# Altium schematic sheet GridSeed Old.SchDoc (part 1 of 2) (continued)
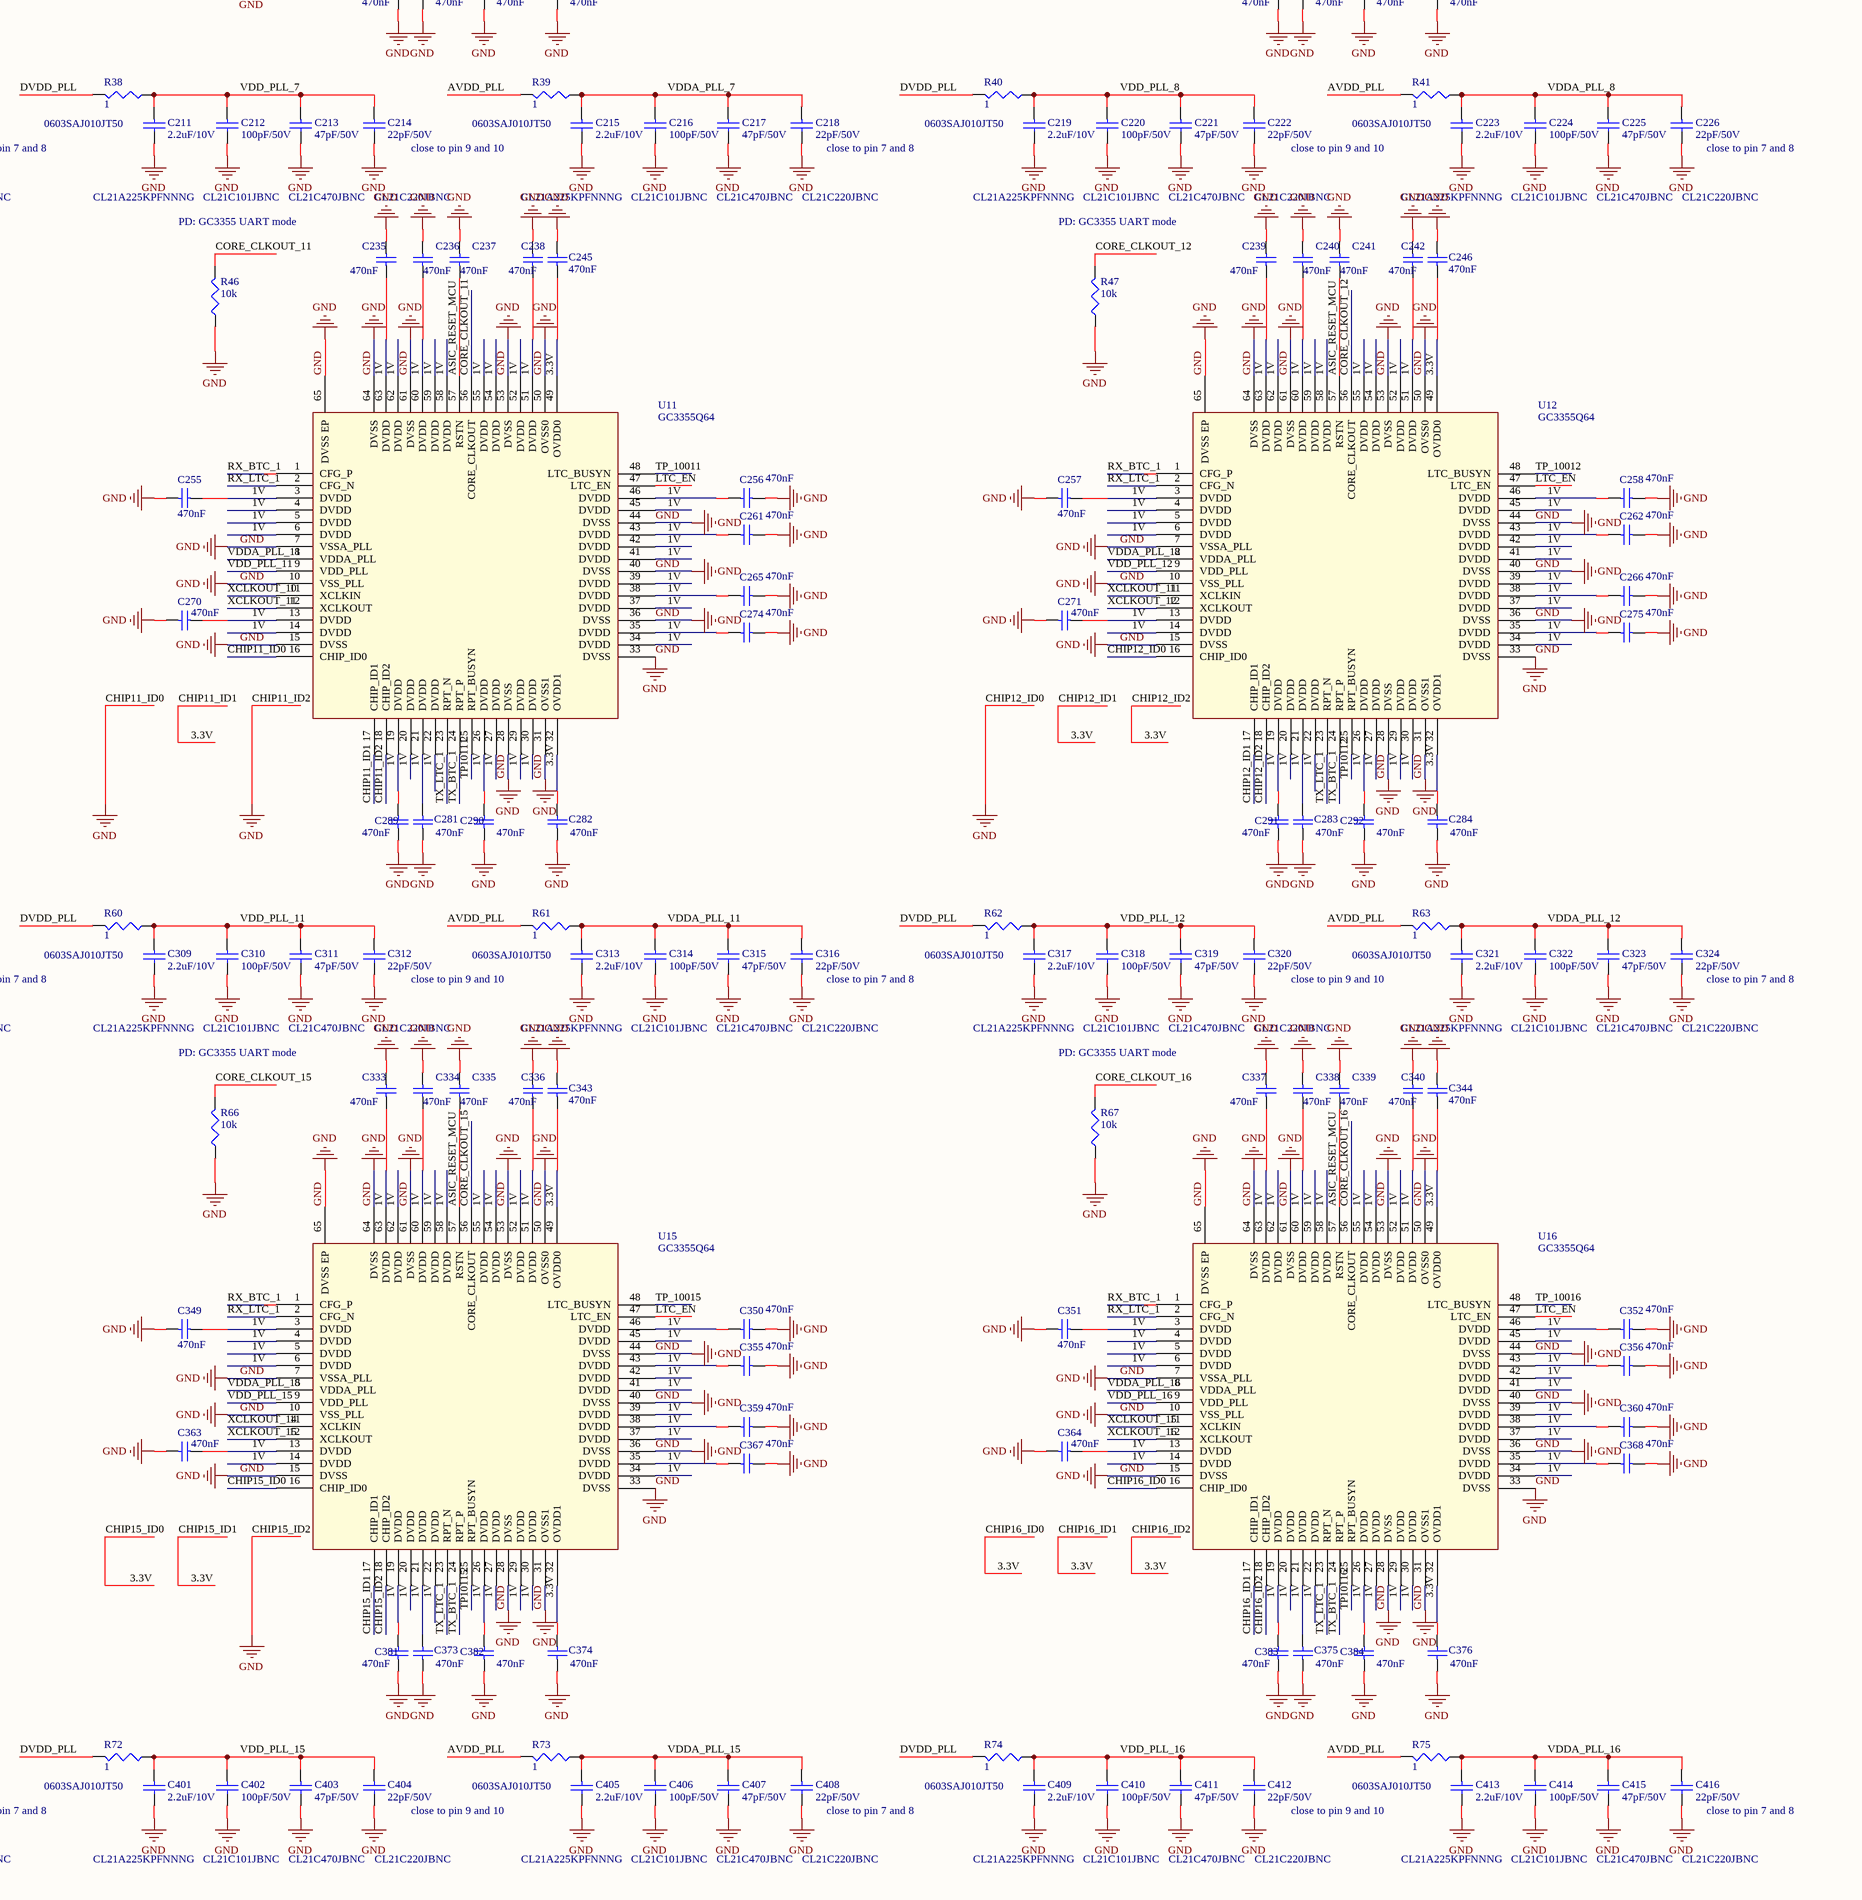
[diagram p4: GridSeed Old.SchDoc, bottom middle]
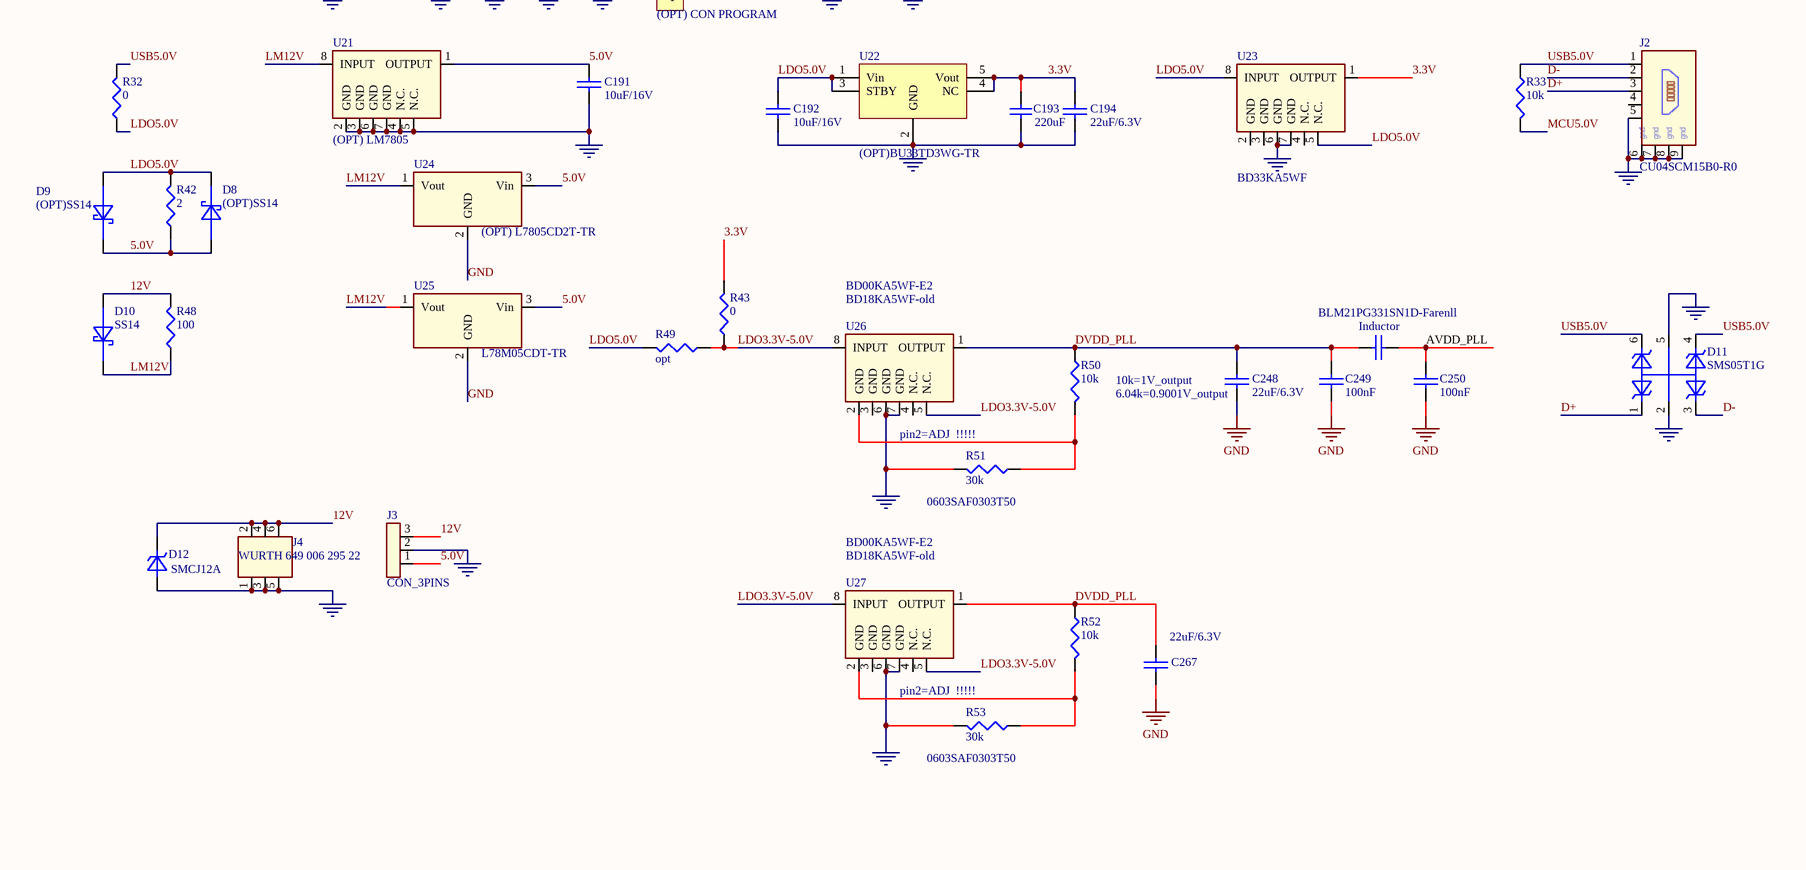
[diagram p5: GridSeed Old.SchDoc, bottom right]

## Parts
C1  10uF/16V  [SMD_0805_CAPC2012X145N]
C2  10uF/16V  [SMD_0805_CAPC2012X145N]
C3  10uF/16V  [SMD_0805_CAPC2012X145N]
C4  1uF/16V  [SMD_0805_CAPC2012X145N]
C5  1uF/16V  [SMD_0805_CAPC2012X145N]
C6  1uF/16V  [SMD_0805_CAPC2012X145N]
C7  100nF/50V  [SMD_0805_CAPC2012X145N]
C8  100nF/50V  [SMD_0805_CAPC2012X145N]
C9  100nF/50V  [SMD_0805_CAPC2012X145N]
C10  100uF  [SMD_1210_CAPC3225X279N]
C11  100uF  [SMD_1210_CAPC3225X279N]
C12  220uF  [SMD_1210_CAPC3225X279N]
C13  220uF  [SMD_1210_CAPC3225X279N]
C14  220uF  [SMD_1210_CAPC3225X279N]
C15  100uF  [SMD_1210_CAPC3225X279N]
C16  100uF  [SMD_1210_CAPC3225X279N]
C17  220uF  [SMD_1210_CAPC3225X279N]
C18  220uF  [SMD_1210_CAPC3225X279N]
C19  220uF  [SMD_1210_CAPC3225X279N]
C20  100uF  [SMD_1210_CAPC3225X279N]
C21  100uF  [SMD_1210_CAPC3225X279N]
C22  220uF  [SMD_1210_CAPC3225X279N]
C23  220uF  [SMD_1210_CAPC3225X279N]
C24  220uF  [SMD_1210_CAPC3225X279N]
C25  470nF  [SMD_0603_CAPC1608X80N]
C26  470nF  [SMD_0603_CAPC1608X80N]
C27  470nF  [SMD_0603_CAPC1608X80N]
C28  470nF  [SMD_0603_CAPC1608X80N]
C29  470nF  [SMD_0603_CAPC1608X80N]
C30  470nF  [SMD_0603_CAPC1608X80N]
C31  470nF  [SMD_0603_CAPC1608X80N]
C32  470nF  [SMD_0603_CAPC1608X80N]
C33  470nF  [SMD_0603_CAPC1608X80N]
C34  470nF  [SMD_0603_CAPC1608X80N]
C35  470nF  [SMD_0603_CAPC1608X80N]
C36  470nF  [SMD_0603_CAPC1608X80N]
C37  470nF  [SMD_0603_CAPC1608X80N]
C38  470nF  [SMD_0603_CAPC1608X80N]
C39  470nF  [SMD_0603_CAPC1608X80N]
C40  470nF  [SMD_0603_CAPC1608X80N]
C41  470nF  [SMD_0603_CAPC1608X80N]
C42  470nF  [SMD_0603_CAPC1608X80N]
C43  470nF  [SMD_0603_CAPC1608X80N]
C44  470nF  [SMD_0603_CAPC1608X80N]
C45  470nF  [SMD_0603_CAPC1608X80N]
C46  470nF  [SMD_0603_CAPC1608X80N]
C47  470nF  [SMD_0603_CAPC1608X80N]
C48  470nF  [SMD_0603_CAPC1608X80N]
C49  470nF  [SMD_0603_CAPC1608X80N]
C50  470nF  [SMD_0603_CAPC1608X80N]
C51  470nF  [SMD_0603_CAPC1608X80N]
C52  470nF  [SMD_0603_CAPC1608X80N]
C53  470nF  [SMD_0603_CAPC1608X80N]
C54  470nF  [SMD_0603_CAPC1608X80N]
C55  470nF  [SMD_0603_CAPC1608X80N]
C56  470nF  [SMD_0603_CAPC1608X80N]
C57  470nF  [SMD_0603_CAPC1608X80N]
C58  470nF  [SMD_0603_CAPC1608X80N]
C59  470nF  [SMD_0603_CAPC1608X80N]
C60  470nF  [SMD_0603_CAPC1608X80N]
C61  470nF  [SMD_0603_CAPC1608X80N]
C62  470nF  [SMD_0603_CAPC1608X80N]
C63  470nF  [SMD_0603_CAPC1608X80N]
C64  470nF  [SMD_0603_CAPC1608X80N]
C65  470nF  [SMD_0603_CAPC1608X80N]
C66  470nF  [SMD_0603_CAPC1608X80N]
C67  470nF  [SMD_0603_CAPC1608X80N]
C68  470nF  [SMD_0603_CAPC1608X80N]
C69  10uF/16V  [SMD_0805_CAPC2012X145N]
C70  470nF  [SMD_0603_CAPC1608X80N]
C71  470nF  [SMD_0603_CAPC1608X80N]
C72  470nF  [SMD_0603_CAPC1608X80N]
C73  470nF  [SMD_0603_CAPC1608X80N]
C74  470nF  [SMD_0603_CAPC1608X80N]
C75  470nF  [SMD_0603_CAPC1608X80N]
C76  470nF  [SMD_0603_CAPC1608X80N]
C77  470nF  [SMD_0603_CAPC1608X80N]
C78  470nF  [SMD_0603_CAPC1608X80N]
C79  470nF  [SMD_0603_CAPC1608X80N]
C80  470nF  [SMD_0603_CAPC1608X80N]
C81  470nF  [SMD_0603_CAPC1608X80N]
C82  470nF  [SMD_0603_CAPC1608X80N]
C83  470nF  [SMD_0603_CAPC1608X80N]
C84  470nF  [SMD_0603_CAPC1608X80N]
C85  470nF  [SMD_0603_CAPC1608X80N]
C86  2.2uF/10V  [SMD_0805_CAPC2012X145N]
C87  100pF/50V  [SMD_0805_CAPC2012X145N]
C88  47pF/50V  [SMD_0805_CAPC2012X145N]
C89  22pF/50V  [SMD_0805_CAPC2012X145N]
C90  2.2uF/10V  [SMD_0805_CAPC2012X145N]
C91  100pF/50V  [SMD_0805_CAPC2012X145N]
C92  47pF/50V  [SMD_0805_CAPC2012X145N]
C93  22pF/50V  [SMD_0805_CAPC2012X145N]
C94  2.2uF/10V  [SMD_0805_CAPC2012X145N]
C95  100pF/50V  [SMD_0805_CAPC2012X145N]
C96  47pF/50V  [SMD_0805_CAPC2012X145N]
C97  22pF/50V  [SMD_0805_CAPC2012X145N]
C98  2.2uF/10V  [SMD_0805_CAPC2012X145N]
C99  100pF/50V  [SMD_0805_CAPC2012X145N]
C100  47pF/50V  [SMD_0805_CAPC2012X145N]
C101  22pF/50V  [SMD_0805_CAPC2012X145N]
C102  2.2uF/10V  [SMD_0805_CAPC2012X145N]
C103  100pF/50V  [SMD_0805_CAPC2012X145N]
C104  47pF/50V  [SMD_0805_CAPC2012X145N]
C105  22pF/50V  [SMD_0805_CAPC2012X145N]
C106  2.2uF/10V  [SMD_0805_CAPC2012X145N]
C107  100pF/50V  [SMD_0805_CAPC2012X145N]
C108  47pF/50V  [SMD_0805_CAPC2012X145N]
C109  22pF/50V  [SMD_0805_CAPC2012X145N]
C110  2.2uF/10V  [SMD_0805_CAPC2012X145N]
C111  100pF/50V  [SMD_0805_CAPC2012X145N]
C112  47pF/50V  [SMD_0805_CAPC2012X145N]
C113  22pF/50V  [SMD_0805_CAPC2012X145N]
C114  2.2uF/10V  [SMD_0805_CAPC2012X145N]
C115  100pF/50V  [SMD_0805_CAPC2012X145N]
C116  47pF/50V  [SMD_0805_CAPC2012X145N]
C117  22pF/50V  [SMD_0805_CAPC2012X145N]
C118  470nF  [SMD_0603_CAPC1608X80N]
C119  470nF  [SMD_0603_CAPC1608X80N]
C120  470nF  [SMD_0603_CAPC1608X80N]
C121  470nF  [SMD_0603_CAPC1608X80N]
C122  470nF  [SMD_0603_CAPC1608X80N]
C123  470nF  [SMD_0603_CAPC1608X80N]
C124  470nF  [SMD_0603_CAPC1608X80N]
C125  470nF  [SMD_0603_CAPC1608X80N]
C126  470nF  [SMD_0603_CAPC1608X80N]
C127  470nF  [SMD_0603_CAPC1608X80N]
C128  470nF  [SMD_0603_CAPC1608X80N]
C129  470nF  [SMD_0603_CAPC1608X80N]
C130  470nF  [SMD_0603_CAPC1608X80N]
C131  470nF  [SMD_0603_CAPC1608X80N]
C132  470nF  [SMD_0603_CAPC1608X80N]
C133  470nF  [SMD_0603_CAPC1608X80N]
C134  470nF  [SMD_0603_CAPC1608X80N]
C135  470nF  [SMD_0603_CAPC1608X80N]
C136  470nF  [SMD_0603_CAPC1608X80N]
C137  470nF  [SMD_0603_CAPC1608X80N]
C138  10uF/16V  [SMD_0805_CAPC2012X145N]
C139  1nF  [SMD_0603_CAPC1608X80N]
C140  470nF  [SMD_0603_CAPC1608X80N]
C141  470nF  [SMD_0603_CAPC1608X80N]
C142  470nF  [SMD_0603_CAPC1608X80N]
C143  470nF  [SMD_0603_CAPC1608X80N]
C144  470nF  [SMD_0603_CAPC1608X80N]
C145  470nF  [SMD_0603_CAPC1608X80N]
C146  470nF  [SMD_0603_CAPC1608X80N]
C147  470nF  [SMD_0603_CAPC1608X80N]
C148  470nF  [SMD_0603_CAPC1608X80N]
C149  470nF  [SMD_0603_CAPC1608X80N]
C150  470nF  [SMD_0603_CAPC1608X80N]
C151  470nF  [SMD_0603_CAPC1608X80N]
C152  1nF  [SMD_0603_CAPC1608X80N]
C153  470nF  [SMD_0603_CAPC1608X80N]
C154  470nF  [SMD_0603_CAPC1608X80N]
C155  470nF  [SMD_0603_CAPC1608X80N]
C156  470nF  [SMD_0603_CAPC1608X80N]
C157  470nF  [SMD_0603_CAPC1608X80N]
C158  470nF  [SMD_0603_CAPC1608X80N]
C159  470nF  [SMD_0603_CAPC1608X80N]
C160  470nF  [SMD_0603_CAPC1608X80N]
C161  470nF  [SMD_0603_CAPC1608X80N]
C162  470nF  [SMD_0603_CAPC1608X80N]
C163  470nF  [SMD_0603_CAPC1608X80N]
C164  470nF  [SMD_0603_CAPC1608X80N]
C165  100nF  [SMD_0603_CAPC1608X80N]
C166  1nF  [SMD_0603_CAPC1608X80N]
C167  1nF  [SMD_0603_CAPC1608X80N]
C168  100nF  [SMD_0603_CAPC1608X80N]
C169  100nF  [SMD_0603_CAPC1608X80N]
C170  100nF  [SMD_0603_CAPC1608X80N]
C171  100nF  [SMD_0603_CAPC1608X80N]
C172  100nF  [SMD_0603_CAPC1608X80N]
C173  18pF  [SMD_0603_CAPC1608X80N]
C174  18pF  [SMD_0603_CAPC1608X80N]
C175  470nF  [SMD_0603_CAPC1608X80N]
C176  470nF  [SMD_0603_CAPC1608X80N]
C177  470nF  [SMD_0603_CAPC1608X80N]
C178  470nF  [SMD_0603_CAPC1608X80N]
C179  470nF  [SMD_0603_CAPC1608X80N]
C180  470nF  [SMD_0603_CAPC1608X80N]
C181  470nF  [SMD_0603_CAPC1608X80N]
C182  470nF  [SMD_0603_CAPC1608X80N]
C183  470nF  [SMD_0603_CAPC1608X80N]
C184  470nF  [SMD_0603_CAPC1608X80N]
C185  470nF  [SMD_0603_CAPC1608X80N]
C186  470nF  [SMD_0603_CAPC1608X80N]
C187  470nF  [SMD_0603_CAPC1608X80N]
C188  470nF  [SMD_0603_CAPC1608X80N]
C189  470nF  [SMD_0603_CAPC1608X80N]
C190  470nF  [SMD_0603_CAPC1608X80N]
C191  10uF/16V  [SMD_0805_CAPC2012X145N]
C192  10uF/16V  [SMD_0805_CAPC2012X145N]
C193  220uF  [SMD_1210_CAPC3225X279N]
C194  22uF/6.3V  [SMD_0805_CAPC2012X145N]
C195  2.2uF/10V  [SMD_0805_CAPC2012X145N]
C196  100pF/50V  [SMD_0805_CAPC2012X145N]
C197  47pF/50V  [SMD_0805_CAPC2012X145N]
C198  22pF/50V  [SMD_0805_CAPC2012X145N]
C199  2.2uF/10V  [SMD_0805_CAPC2012X145N]
C200  100pF/50V  [SMD_0805_CAPC2012X145N]
C201  47pF/50V  [SMD_0805_CAPC2012X145N]
C202  22pF/50V  [SMD_0805_CAPC2012X145N]
C203  2.2uF/10V  [SMD_0805_CAPC2012X145N]
C204  100pF/50V  [SMD_0805_CAPC2012X145N]
C205  47pF/50V  [SMD_0805_CAPC2012X145N]
C206  22pF/50V  [SMD_0805_CAPC2012X145N]
C207  2.2uF/10V  [SMD_0805_CAPC2012X145N]
C208  100pF/50V  [SMD_0805_CAPC2012X145N]
C209  47pF/50V  [SMD_0805_CAPC2012X145N]
C210  22pF/50V  [SMD_0805_CAPC2012X145N]
C211  2.2uF/10V  [SMD_0805_CAPC2012X145N]
C212  100pF/50V  [SMD_0805_CAPC2012X145N]
C213  47pF/50V  [SMD_0805_CAPC2012X145N]
C214  22pF/50V  [SMD_0805_CAPC2012X145N]
C215  2.2uF/10V  [SMD_0805_CAPC2012X145N]
C216  100pF/50V  [SMD_0805_CAPC2012X145N]
C217  47pF/50V  [SMD_0805_CAPC2012X145N]
C218  22pF/50V  [SMD_0805_CAPC2012X145N]
C219  2.2uF/10V  [SMD_0805_CAPC2012X145N]
C220  100pF/50V  [SMD_0805_CAPC2012X145N]
C221  47pF/50V  [SMD_0805_CAPC2012X145N]
C222  22pF/50V  [SMD_0805_CAPC2012X145N]
C223  2.2uF/10V  [SMD_0805_CAPC2012X145N]
C224  100pF/50V  [SMD_0805_CAPC2012X145N]
C225  47pF/50V  [SMD_0805_CAPC2012X145N]
C226  22pF/50V  [SMD_0805_CAPC2012X145N]
C227  470nF  [SMD_0603_CAPC1608X80N]
C228  470nF  [SMD_0603_CAPC1608X80N]
C229  470nF  [SMD_0603_CAPC1608X80N]
C230  470nF  [SMD_0603_CAPC1608X80N]
C231  470nF  [SMD_0603_CAPC1608X80N]
C232  470nF  [SMD_0603_CAPC1608X80N]
C233  470nF  [SMD_0603_CAPC1608X80N]
C234  470nF  [SMD_0603_CAPC1608X80N]
C235  470nF  [SMD_0603_CAPC1608X80N]
C236  470nF  [SMD_0603_CAPC1608X80N]
C237  470nF  [SMD_0603_CAPC1608X80N]
C238  470nF  [SMD_0603_CAPC1608X80N]
C239  470nF  [SMD_0603_CAPC1608X80N]
C240  470nF  [SMD_0603_CAPC1608X80N]
C241  470nF  [SMD_0603_CAPC1608X80N]
C242  470nF  [SMD_0603_CAPC1608X80N]
C243  470nF  [SMD_0603_CAPC1608X80N]
C244  470nF  [SMD_0603_CAPC1608X80N]
C245  470nF  [SMD_0603_CAPC1608X80N]
C246  470nF  [SMD_0603_CAPC1608X80N]
C247  Inductor  [SMD_0805_CAPC2012X145N]
C248  22uF/6.3V  [SMD_0805_CAPC2012X145N]
C249  100nF  [SMD_0603_CAPC1608X80N]
C250  100nF  [SMD_0603_CAPC1608X80N]
C251  470nF  [SMD_0603_CAPC1608X80N]
C252  470nF  [SMD_0603_CAPC1608X80N]
C253  470nF  [SMD_0603_CAPC1608X80N]
C254  470nF  [SMD_0603_CAPC1608X80N]
C255  470nF  [SMD_0603_CAPC1608X80N]
C256  470nF  [SMD_0603_CAPC1608X80N]
C257  470nF  [SMD_0603_CAPC1608X80N]
C258  470nF  [SMD_0603_CAPC1608X80N]
C259  470nF  [SMD_0603_CAPC1608X80N]
C260  470nF  [SMD_0603_CAPC1608X80N]
C261  470nF  [SMD_0603_CAPC1608X80N]
C262  470nF  [SMD_0603_CAPC1608X80N]
C263  470nF  [SMD_0603_CAPC1608X80N]
C264  470nF  [SMD_0603_CAPC1608X80N]
C265  470nF  [SMD_0603_CAPC1608X80N]
C266  470nF  [SMD_0603_CAPC1608X80N]
C267  22uF/6.3V  [SMD_0805_CAPC2012X145N]
C268  470nF  [SMD_0603_CAPC1608X80N]
C269  470nF  [SMD_0603_CAPC1608X80N]
C270  470nF  [SMD_0603_CAPC1608X80N]
C271  470nF  [SMD_0603_CAPC1608X80N]
C272  470nF  [SMD_0603_CAPC1608X80N]
C273  470nF  [SMD_0603_CAPC1608X80N]
C274  470nF  [SMD_0603_CAPC1608X80N]
C275  470nF  [SMD_0603_CAPC1608X80N]
C276  10uF/16V  [SMD_0805_CAPC2012X145N]
C277  470nF  [SMD_0603_CAPC1608X80N]
C278  470nF  [SMD_0603_CAPC1608X80N]
C279  470nF  [SMD_0603_CAPC1608X80N]
C280  470nF  [SMD_0603_CAPC1608X80N]
C281  470nF  [SMD_0603_CAPC1608X80N]
C282  470nF  [SMD_0603_CAPC1608X80N]
C283  470nF  [SMD_0603_CAPC1608X80N]
C284  470nF  [SMD_0603_CAPC1608X80N]
C285  470nF  [SMD_0603_CAPC1608X80N]
C286  470nF  [SMD_0603_CAPC1608X80N]
C287  470nF  [SMD_0603_CAPC1608X80N]
C288  470nF  [SMD_0603_CAPC1608X80N]
C289  470nF  [SMD_0603_CAPC1608X80N]
C290  470nF  [SMD_0603_CAPC1608X80N]
C291  470nF  [SMD_0603_CAPC1608X80N]
C292  470nF  [SMD_0603_CAPC1608X80N]
C293  2.2uF/10V  [SMD_0805_CAPC2012X145N]
C294  100pF/50V  [SMD_0805_CAPC2012X145N]
C295  47pF/50V  [SMD_0805_CAPC2012X145N]
C296  22pF/50V  [SMD_0805_CAPC2012X145N]
C297  2.2uF/10V  [SMD_0805_CAPC2012X145N]
C298  100pF/50V  [SMD_0805_CAPC2012X145N]
C299  47pF/50V  [SMD_0805_CAPC2012X145N]
C300  22pF/50V  [SMD_0805_CAPC2012X145N]
C301  2.2uF/10V  [SMD_0805_CAPC2012X145N]
C302  100pF/50V  [SMD_0805_CAPC2012X145N]
C303  47pF/50V  [SMD_0805_CAPC2012X145N]
C304  22pF/50V  [SMD_0805_CAPC2012X145N]
C305  2.2uF/10V  [SMD_0805_CAPC2012X145N]
C306  100pF/50V  [SMD_0805_CAPC2012X145N]
C307  47pF/50V  [SMD_0805_CAPC2012X145N]
C308  22pF/50V  [SMD_0805_CAPC2012X145N]
C309  2.2uF/10V  [SMD_0805_CAPC2012X145N]
C310  100pF/50V  [SMD_0805_CAPC2012X145N]
C311  47pF/50V  [SMD_0805_CAPC2012X145N]
C312  22pF/50V  [SMD_0805_CAPC2012X145N]
C313  2.2uF/10V  [SMD_0805_CAPC2012X145N]
C314  100pF/50V  [SMD_0805_CAPC2012X145N]
C315  47pF/50V  [SMD_0805_CAPC2012X145N]
C316  22pF/50V  [SMD_0805_CAPC2012X145N]
C317  2.2uF/10V  [SMD_0805_CAPC2012X145N]
C318  100pF/50V  [SMD_0805_CAPC2012X145N]
C319  47pF/50V  [SMD_0805_CAPC2012X145N]
C320  22pF/50V  [SMD_0805_CAPC2012X145N]
C321  2.2uF/10V  [SMD_0805_CAPC2012X145N]
C322  100pF/50V  [SMD_0805_CAPC2012X145N]
C323  47pF/50V  [SMD_0805_CAPC2012X145N]
C324  22pF/50V  [SMD_0805_CAPC2012X145N]
C325  470nF  [SMD_0603_CAPC1608X80N]
C326  470nF  [SMD_0603_CAPC1608X80N]
C327  470nF  [SMD_0603_CAPC1608X80N]
C328  470nF  [SMD_0603_CAPC1608X80N]
C329  470nF  [SMD_0603_CAPC1608X80N]
C330  470nF  [SMD_0603_CAPC1608X80N]
C331  470nF  [SMD_0603_CAPC1608X80N]
C332  470nF  [SMD_0603_CAPC1608X80N]
C333  470nF  [SMD_0603_CAPC1608X80N]
C334  470nF  [SMD_0603_CAPC1608X80N]
C335  470nF  [SMD_0603_CAPC1608X80N]
C336  470nF  [SMD_0603_CAPC1608X80N]
C337  470nF  [SMD_0603_CAPC1608X80N]
C338  470nF  [SMD_0603_CAPC1608X80N]
C339  470nF  [SMD_0603_CAPC1608X80N]
C340  470nF  [SMD_0603_CAPC1608X80N]
C341  470nF  [SMD_0603_CAPC1608X80N]
C342  470nF  [SMD_0603_CAPC1608X80N]
C343  470nF  [SMD_0603_CAPC1608X80N]
C344  470nF  [SMD_0603_CAPC1608X80N]
C345  470nF  [SMD_0603_CAPC1608X80N]
C346  470nF  [SMD_0603_CAPC1608X80N]
C347  470nF  [SMD_0603_CAPC1608X80N]
C348  470nF  [SMD_0603_CAPC1608X80N]
C349  470nF  [SMD_0603_CAPC1608X80N]
C350  470nF  [SMD_0603_CAPC1608X80N]
C351  470nF  [SMD_0603_CAPC1608X80N]
C352  470nF  [SMD_0603_CAPC1608X80N]
C353  470nF  [SMD_0603_CAPC1608X80N]
C354  470nF  [SMD_0603_CAPC1608X80N]
C355  470nF  [SMD_0603_CAPC1608X80N]
C356  470nF  [SMD_0603_CAPC1608X80N]
C357  470nF  [SMD_0603_CAPC1608X80N]
C358  470nF  [SMD_0603_CAPC1608X80N]
C359  470nF  [SMD_0603_CAPC1608X80N]
C360  470nF  [SMD_0603_CAPC1608X80N]
C361  470nF  [SMD_0603_CAPC1608X80N]
C362  470nF  [SMD_0603_CAPC1608X80N]
C363  470nF  [SMD_0603_CAPC1608X80N]
C364  470nF  [SMD_0603_CAPC1608X80N]
C365  470nF  [SMD_0603_CAPC1608X80N]
C366  470nF  [SMD_0603_CAPC1608X80N]
C367  470nF  [SMD_0603_CAPC1608X80N]
C368  470nF  [SMD_0603_CAPC1608X80N]
C369  470nF  [SMD_0603_CAPC1608X80N]
C370  470nF  [SMD_0603_CAPC1608X80N]
C371  470nF  [SMD_0603_CAPC1608X80N]
C372  470nF  [SMD_0603_CAPC1608X80N]
C373  470nF  [SMD_0603_CAPC1608X80N]
C374  470nF  [SMD_0603_CAPC1608X80N]
C375  470nF  [SMD_0603_CAPC1608X80N]
C376  470nF  [SMD_0603_CAPC1608X80N]
C377  470nF  [SMD_0603_CAPC1608X80N]
C378  470nF  [SMD_0603_CAPC1608X80N]
C379  470nF  [SMD_0603_CAPC1608X80N]
C380  470nF  [SMD_0603_CAPC1608X80N]
C381  470nF  [SMD_0603_CAPC1608X80N]
C382  470nF  [SMD_0603_CAPC1608X80N]
C383  470nF  [SMD_0603_CAPC1608X80N]
C384  470nF  [SMD_0603_CAPC1608X80N]
C385  2.2uF/10V  [SMD_0805_CAPC2012X145N]
C386  100pF/50V  [SMD_0805_CAPC2012X145N]
C387  47pF/50V  [SMD_0805_CAPC2012X145N]
C388  22pF/50V  [SMD_0805_CAPC2012X145N]
C389  2.2uF/10V  [SMD_0805_CAPC2012X145N]
C390  100pF/50V  [SMD_0805_CAPC2012X145N]
C391  47pF/50V  [SMD_0805_CAPC2012X145N]
C392  22pF/50V  [SMD_0805_CAPC2012X145N]
C393  2.2uF/10V  [SMD_0805_CAPC2012X145N]
C394  100pF/50V  [SMD_0805_CAPC2012X145N]
C395  47pF/50V  [SMD_0805_CAPC2012X145N]
C396  22pF/50V  [SMD_0805_CAPC2012X145N]
C397  2.2uF/10V  [SMD_0805_CAPC2012X145N]
C398  100pF/50V  [SMD_0805_CAPC2012X145N]
C399  47pF/50V  [SMD_0805_CAPC2012X145N]
C400  22pF/50V  [SMD_0805_CAPC2012X145N]
C401  2.2uF/10V  [SMD_0805_CAPC2012X145N]
C402  100pF/50V  [SMD_0805_CAPC2012X145N]
C403  47pF/50V  [SMD_0805_CAPC2012X145N]
C404  22pF/50V  [SMD_0805_CAPC2012X145N]
C405  2.2uF/10V  [SMD_0805_CAPC2012X145N]
C406  100pF/50V  [SMD_0805_CAPC2012X145N]
C407  47pF/50V  [SMD_0805_CAPC2012X145N]
C408  22pF/50V  [SMD_0805_CAPC2012X145N]
C409  2.2uF/10V  [SMD_0805_CAPC2012X145N]
C410  100pF/50V  [SMD_0805_CAPC2012X145N]
C411  47pF/50V  [SMD_0805_CAPC2012X145N]
C412  22pF/50V  [SMD_0805_CAPC2012X145N]
C413  2.2uF/10V  [SMD_0805_CAPC2012X145N]
C414  100pF/50V  [SMD_0805_CAPC2012X145N]
C415  47pF/50V  [SMD_0805_CAPC2012X145N]
C416  22pF/50V  [SMD_0805_CAPC2012X145N]
C_1  (OPT)220uF  [SMD_1210_CAPC3225X279N]
C_2  (OPT)220uF  [SMD_1210_CAPC3225X279N]
C_3  (OPT)220uF  [SMD_1210_CAPC3225X279N]
C_4  (OPT)220uF  [SMD_1210_CAPC3225X279N]
C_5  (OPT)220uF  [SMD_1210_CAPC3225X279N]
C_6  (OPT)220uF  [SMD_1210_CAPC3225X279N]
C_7  (OPT)220uF  [SMD_1210_CAPC3225X279N]
C_8  (OPT)220uF  [SMD_1210_CAPC3225X279N]
C_9  (OPT)220uF  [SMD_1210_CAPC3225X279N]
C_10  (OPT)220uF  [SMD_1210_CAPC3225X279N]
C_11  (OPT)220uF  [SMD_1210_CAPC3225X279N]
C_12  (OPT)220uF  [SMD_1210_CAPC3225X279N]
C_13  (OPT)220uF  [SMD_1210_CAPC3225X279N]
C_14  (OPT)220uF  [SMD_1210_CAPC3225X279N]
C_15  (OPT)220uF  [SMD_1210_CAPC3225X279N]
C_16  (OPT)220uF  [SMD_1210_CAPC3225X279N]
C_17  (OPT)220uF  [SMD_1210_CAPC3225X279N]
C_18  (OPT)220uF  [SMD_1210_CAPC3225X279N]
C_19  (OPT)220uF  [SMD_1210_CAPC3225X279N]
C_20  (OPT)220uF  [SMD_1210_CAPC3225X279N]
C_21  (OPT)220uF  [SMD_1210_CAPC3225X279N]
C_22  (OPT)220uF  [SMD_1210_CAPC3225X279N]
C_23  (OPT)220uF  [SMD_1210_CAPC3225X279N]
C_24  (OPT)220uF  [SMD_1210_CAPC3225X279N]
C_25  (OPT)220uF  [SMD_1210_CAPC3225X279N]
C_26  (OPT)220uF  [SMD_1210_CAPC3225X279N]
C_27  (OPT)220uF  [SMD_1210_CAPC3225X279N]
C_28  (OPT)220uF  [SMD_1210_CAPC3225X279N]
C_29  (OPT)220uF  [SMD_1210_CAPC3225X279N]
C_30  (OPT)220uF  [SMD_1210_CAPC3225X279N]
C_31  (OPT)220uF  [SMD_1210_CAPC3225X279N]
C_32  (OPT)220uF  [SMD_1210_CAPC3225X279N]
C_33  (OPT)220uF  [SMD_1210_CAPC3225X279N]
C_34  (OPT)220uF  [SMD_1210_CAPC3225X279N]
C_35  (OPT)220uF  [SMD_1210_CAPC3225X279N]
C_36  (OPT)220uF  [SMD_1210_CAPC3225X279N]
C_37  (OPT)220uF  [SMD_1210_CAPC3225X279N]
C_38  (OPT)220uF  [SMD_1210_CAPC3225X279N]
C_39  (OPT)220uF  [SMD_1210_CAPC3225X279N]
C_40  (OPT)220uF  [SMD_1210_CAPC3225X279N]
C_41  (OPT)220uF  [SMD_1210_CAPC3225X279N]
C_42  (OPT)220uF  [SMD_1210_CAPC3225X279N]
C_43  (OPT)220uF  [SMD_1210_CAPC3225X279N]
C_44  (OPT)220uF  [SMD_1210_CAPC3225X279N]
C_45  (OPT)220uF  [SMD_1210_CAPC3225X279N]
C_46  (OPT)220uF  [SMD_1210_CAPC3225X279N]
C_47  (OPT)220uF  [SMD_1210_CAPC3225X279N]
C_48  (OPT)220uF  [SMD_1210_CAPC3225X279N]
C_49  (OPT)220uF  [SMD_1210_CAPC3225X279N]
C_50  (OPT)220uF  [SMD_1210_CAPC3225X279N]
C_51  (OPT)220uF  [SMD_1210_CAPC3225X279N]
C_52  (OPT)220uF  [SMD_1210_CAPC3225X279N]
C_53  (OPT)220uF  [SMD_1210_CAPC3225X279N]
C_54  (OPT)220uF  [SMD_1210_CAPC3225X279N]
C_55  (OPT)220uF  [SMD_1210_CAPC3225X279N]
C_56  (OPT)220uF  [SMD_1210_CAPC3225X279N]
C_57  (OPT)220uF  [SMD_1210_CAPC3225X279N]
C_58  (OPT)220uF  [SMD_1210_CAPC3225X279N]
C_59  (OPT)220uF  [SMD_1210_CAPC3225X279N]
C_60  (OPT)220uF  [SMD_1210_CAPC3225X279N]
C_61  (OPT)220uF  [SMD_1210_CAPC3225X279N]
C_62  (OPT)220uF  [SMD_1210_CAPC3225X279N]
C_63  (OPT)220uF  [SMD_1210_CAPC3225X279N]
C_64  (OPT)220uF  [SMD_1210_CAPC3225X279N]
C_65  (OPT)220uF  [SMD_1210_CAPC3225X279N]
C_66  (OPT)220uF  [SMD_1210_CAPC3225X279N]
C_67  (OPT)220uF  [SMD_1210_CAPC3225X279N]
C_68  (OPT)220uF  [SMD_1210_CAPC3225X279N]
C_69  (OPT)220uF  [SMD_1210_CAPC3225X279N]
C_70  (OPT)220uF  [SMD_1210_CAPC3225X279N]
C_71  (OPT)220uF  [SMD_1210_CAPC3225X279N]
C_72  (OPT)220uF  [SMD_1210_CAPC3225X279N]
D1  BAT54C  [SMD_SOT23_SOT95P240X120-3N]
D2  BAT54C  [SMD_SOT23_SOT95P240X120-3N]
D3  BAT54C  [SMD_SOT23_SOT95P240X120-3N]
D4  Red SML210VT ROHM  [SMD_0805_LED2012X100N]
D5  Green 	SML210MT ROHM  [SMD_0805_LED2012X100N]
D6  Yellow SML210YT ROHM  [SMD_0805_LED2012X100N]
D7  Orange 	SML210DT ROHM  [SMD_0805_LED2012X100N]
D8  (OPT)SS14  [SMD_DO214AC_SMA]
D9  (OPT)SS14  [SMD_DO214AC_SMA]
D10  SS14  [SMD_DO214AC_SMA]
D11  SMS05T1G  [SMD_SOT95P280X145-6N-W]
D12  SMCJ12A  [SMD_DO214AC_SMC]
J1  (OPT) CON PROGRAM  [SIP5 PGM TOP]
J2  CU04SCM15B0-R0  [SMD_CON-CVILUX-CU04-SCM15B0]
J3  CON_3PINS  [PTH_CON_3.5mm_3PINs]
J4  WURTH 649 006 295 22  [PTH_CON_PCI-E]
L1  SLC1480-201MLD  [SMD_INDM12501250X800A - Coilcraft SLC1480]
L2  SLC1480-201MLD  [SMD_INDM12501250X800A - Coilcraft SLC1480]
L3  SLC1480-201MLD  [SMD_INDM12501250X800A - Coilcraft SLC1480]
Q1  AP1RA03GMT-3  [SMD_SON127P615X520X100-8N]
Q2  AP1RA03GMT-3  [SMD_SON127P615X520X100-8N]
Q3  AP1RA03GMT-3  [SMD_SON127P615X520X100-8N]
Q4  AP1RA03GMT-3  [SMD_SON127P615X520X100-8N]
Q5  AP1RA03GMT-3  [SMD_SON127P615X520X100-8N]
Q6  AP1RA03GMT-3  [SMD_SON127P615X520X100-8N]
Q7  AP1RA03GMT-3  [SMD_SON127P615X520X100-8N]
Q8  AP1RA03GMT-3  [SMD_SON127P615X520X100-8N]
Q9  AP1RA03GMT-3  [SMD_SON127P615X520X100-8N]
R1  10k  [SMD_0603_RESC1608X55N]
R2  10k  [SMD_0603_RESC1608X55N]
R3  10k  [SMD_0603_RESC1608X55N]
R4  10k  [SMD_0603_RESC1608X55N]
R5  10k  [SMD_0603_RESC1608X55N]
R6  10k  [SMD_0603_RESC1608X55N]
R7  10k  [SMD_0603_RESC1608X55N]
R8  10k  [SMD_0603_RESC1608X55N]
R9  1  [SMD_0603_RESC1608X55N]
R10  1  [SMD_0603_RESC1608X55N]
R11  1  [SMD_0603_RESC1608X55N]
R12  1  [SMD_0603_RESC1608X55N]
R13  1  [SMD_0603_RESC1608X55N]
R14  1  [SMD_0603_RESC1608X55N]
R15  1  [SMD_0603_RESC1608X55N]
R16  1  [SMD_0603_RESC1608X55N]
R17  10k  [SMD_0603_RESC1608X55N]
R18  10k  [SMD_0603_RESC1608X55N]
R19  10k  [SMD_0603_RESC1608X55N]
R20  10k  [SMD_0603_RESC1608X55N]
R21  10k  [SMD_0603_RESC1608X55N]
R22  10k  [SMD_0603_RESC1608X55N]
R23  10k  [SMD_0603_RESC1608X55N]
R24  10k  [SMD_0603_RESC1608X55N]
R25  2.4k  [SMD_0603_RESC1608X55N]
R26  47  [SMD_0603_RESC1608X55N]
R27  10k  [SMD_0603_RESC1608X55N]
R28  47  [SMD_0603_RESC1608X55N]
R29  10k  [SMD_0603_RESC1608X55N]
R30  10k  [SMD_0603_RESC1608X55N]
R31  10k  [SMD_0603_RESC1608X55N]
R32  0  [SMD_0603_RESC1608X55N]
R33  10k  [SMD_0603_RESC1608X55N]
R34  1  [SMD_0603_RESC1608X55N]
R35  1  [SMD_0603_RESC1608X55N]
R36  1  [SMD_0603_RESC1608X55N]
R37  1  [SMD_0603_RESC1608X55N]
R38  1  [SMD_0603_RESC1608X55N]
R39  1  [SMD_0603_RESC1608X55N]
R40  1  [SMD_0603_RESC1608X55N]
R41  1  [SMD_0603_RESC1608X55N]
R42  2  [SMD_1206_RESC3216X180N]
R43  0  [SMD_1206_RESC3216X180N]
R44  10k  [SMD_0603_RESC1608X55N]
R45  10k  [SMD_0603_RESC1608X55N]
R46  10k  [SMD_0603_RESC1608X55N]
R47  10k  [SMD_0603_RESC1608X55N]
R48  100  [SMD_1206_RESC3216X180N]
R49  opt  [SMD_1206_RESC3216X180N]
R50  10k  [SMD_0603_RESC1608X55N]
R51  30k  [SMD_0603_RESC1608X55N]
R52  10k  [SMD_0603_RESC1608X55N]
R53  30k  [SMD_0603_RESC1608X55N]
R54  10k  [SMD_0603_RESC1608X55N]
R55  10k  [SMD_0603_RESC1608X55N]
R56  1  [SMD_0603_RESC1608X55N]
R57  1  [SMD_0603_RESC1608X55N]
R58  1  [SMD_0603_RESC1608X55N]
R59  1  [SMD_0603_RESC1608X55N]
R60  1  [SMD_0603_RESC1608X55N]
R61  1  [SMD_0603_RESC1608X55N]
R62  1  [SMD_0603_RESC1608X55N]
R63  1  [SMD_0603_RESC1608X55N]
R64  10k  [SMD_0603_RESC1608X55N]
R65  10k  [SMD_0603_RESC1608X55N]
R66  10k  [SMD_0603_RESC1608X55N]
R67  10k  [SMD_0603_RESC1608X55N]
R68  1  [SMD_0603_RESC1608X55N]
R69  1  [SMD_0603_RESC1608X55N]
R70  1  [SMD_0603_RESC1608X55N]
R71  1  [SMD_0603_RESC1608X55N]
R72  1  [SMD_0603_RESC1608X55N]
R73  1  [SMD_0603_RESC1608X55N]
R74  1  [SMD_0603_RESC1608X55N]
R75  1  [SMD_0603_RESC1608X55N]
U1  GC3355Q64  [SMD_QFN50P800X800X80-65N - GRIDSEED]
U2  GC3355Q64  [SMD_QFN50P800X800X80-65N - GRIDSEED]
U3  GC3355Q64  [SMD_QFN50P800X800X80-65N - GRIDSEED]
U4  GC3355Q64  [SMD_QFN50P800X800X80-65N - GRIDSEED]
U5  GC3355Q64  [SMD_QFN50P800X800X80-65N - GRIDSEED]
U6  GC3355Q64  [SMD_QFN50P800X800X80-65N - GRIDSEED]
U7  GC3355Q64  [SMD_QFN50P800X800X80-65N - GRIDSEED]
U8  GC3355Q64  [SMD_QFN50P800X800X80-65N - GRIDSEED]
U9  GC3355Q64  [SMD_QFN50P800X800X80-65N - GRIDSEED]
U10  GC3355Q64  [SMD_QFN50P800X800X80-65N - GRIDSEED]
U11  GC3355Q64  [SMD_QFN50P800X800X80-65N - GRIDSEED]
U12  GC3355Q64  [SMD_QFN50P800X800X80-65N - GRIDSEED]
U13  GC3355Q64  [SMD_QFN50P800X800X80-65N - GRIDSEED]
U14  GC3355Q64  [SMD_QFN50P800X800X80-65N - GRIDSEED]
U15  GC3355Q64  [SMD_QFN50P800X800X80-65N - GRIDSEED]
U16  GC3355Q64  [SMD_QFN50P800X800X80-65N - GRIDSEED]
U17  LTC 4449  [SMD_DFN16166SON50P161X161X60-9N - LTC4449]
U18  LTC 4449  [SMD_DFN16166SON50P161X161X60-9N - LTC4449]
U19  LTC 4449  [SMD_DFN16166SON50P161X161X60-9N - LTC4449]
U20  dsPIC33EP256MU806  [SMD_QFP50P1200X1200X120-64N]
U21  (OPT) LM7805  [SMD_SOIC127P602X173-8N]
U22  (OPT)BU33TD3WG-TR  [SMD_SOT26_SOT95P285X140-5N - DLV]
U23  BD33KA5WF  [SMD_SOIC127P602X173-8N]
U24  (OPT) L7805CD2T-TR  [SMD_TO254P1524X483-3_4N_D2PAK]
U25  L78M05CDT-TR  [SMD_TO229P991X239-4AN_DPAK]
U26  BD18KA5WF-old  [SMD_SOIC127P602X173-8N]
U27  BD18KA5WF-old  [SMD_SOIC127P602X173-8N]
Y1  Q4.000 MHz HC-49SM SMD  [SMD_HC49_XTAL1140X480X420N]